# EasyEDA Pro project Athena.epro, schematic Schematic, sheet 2 of 4 (continued)
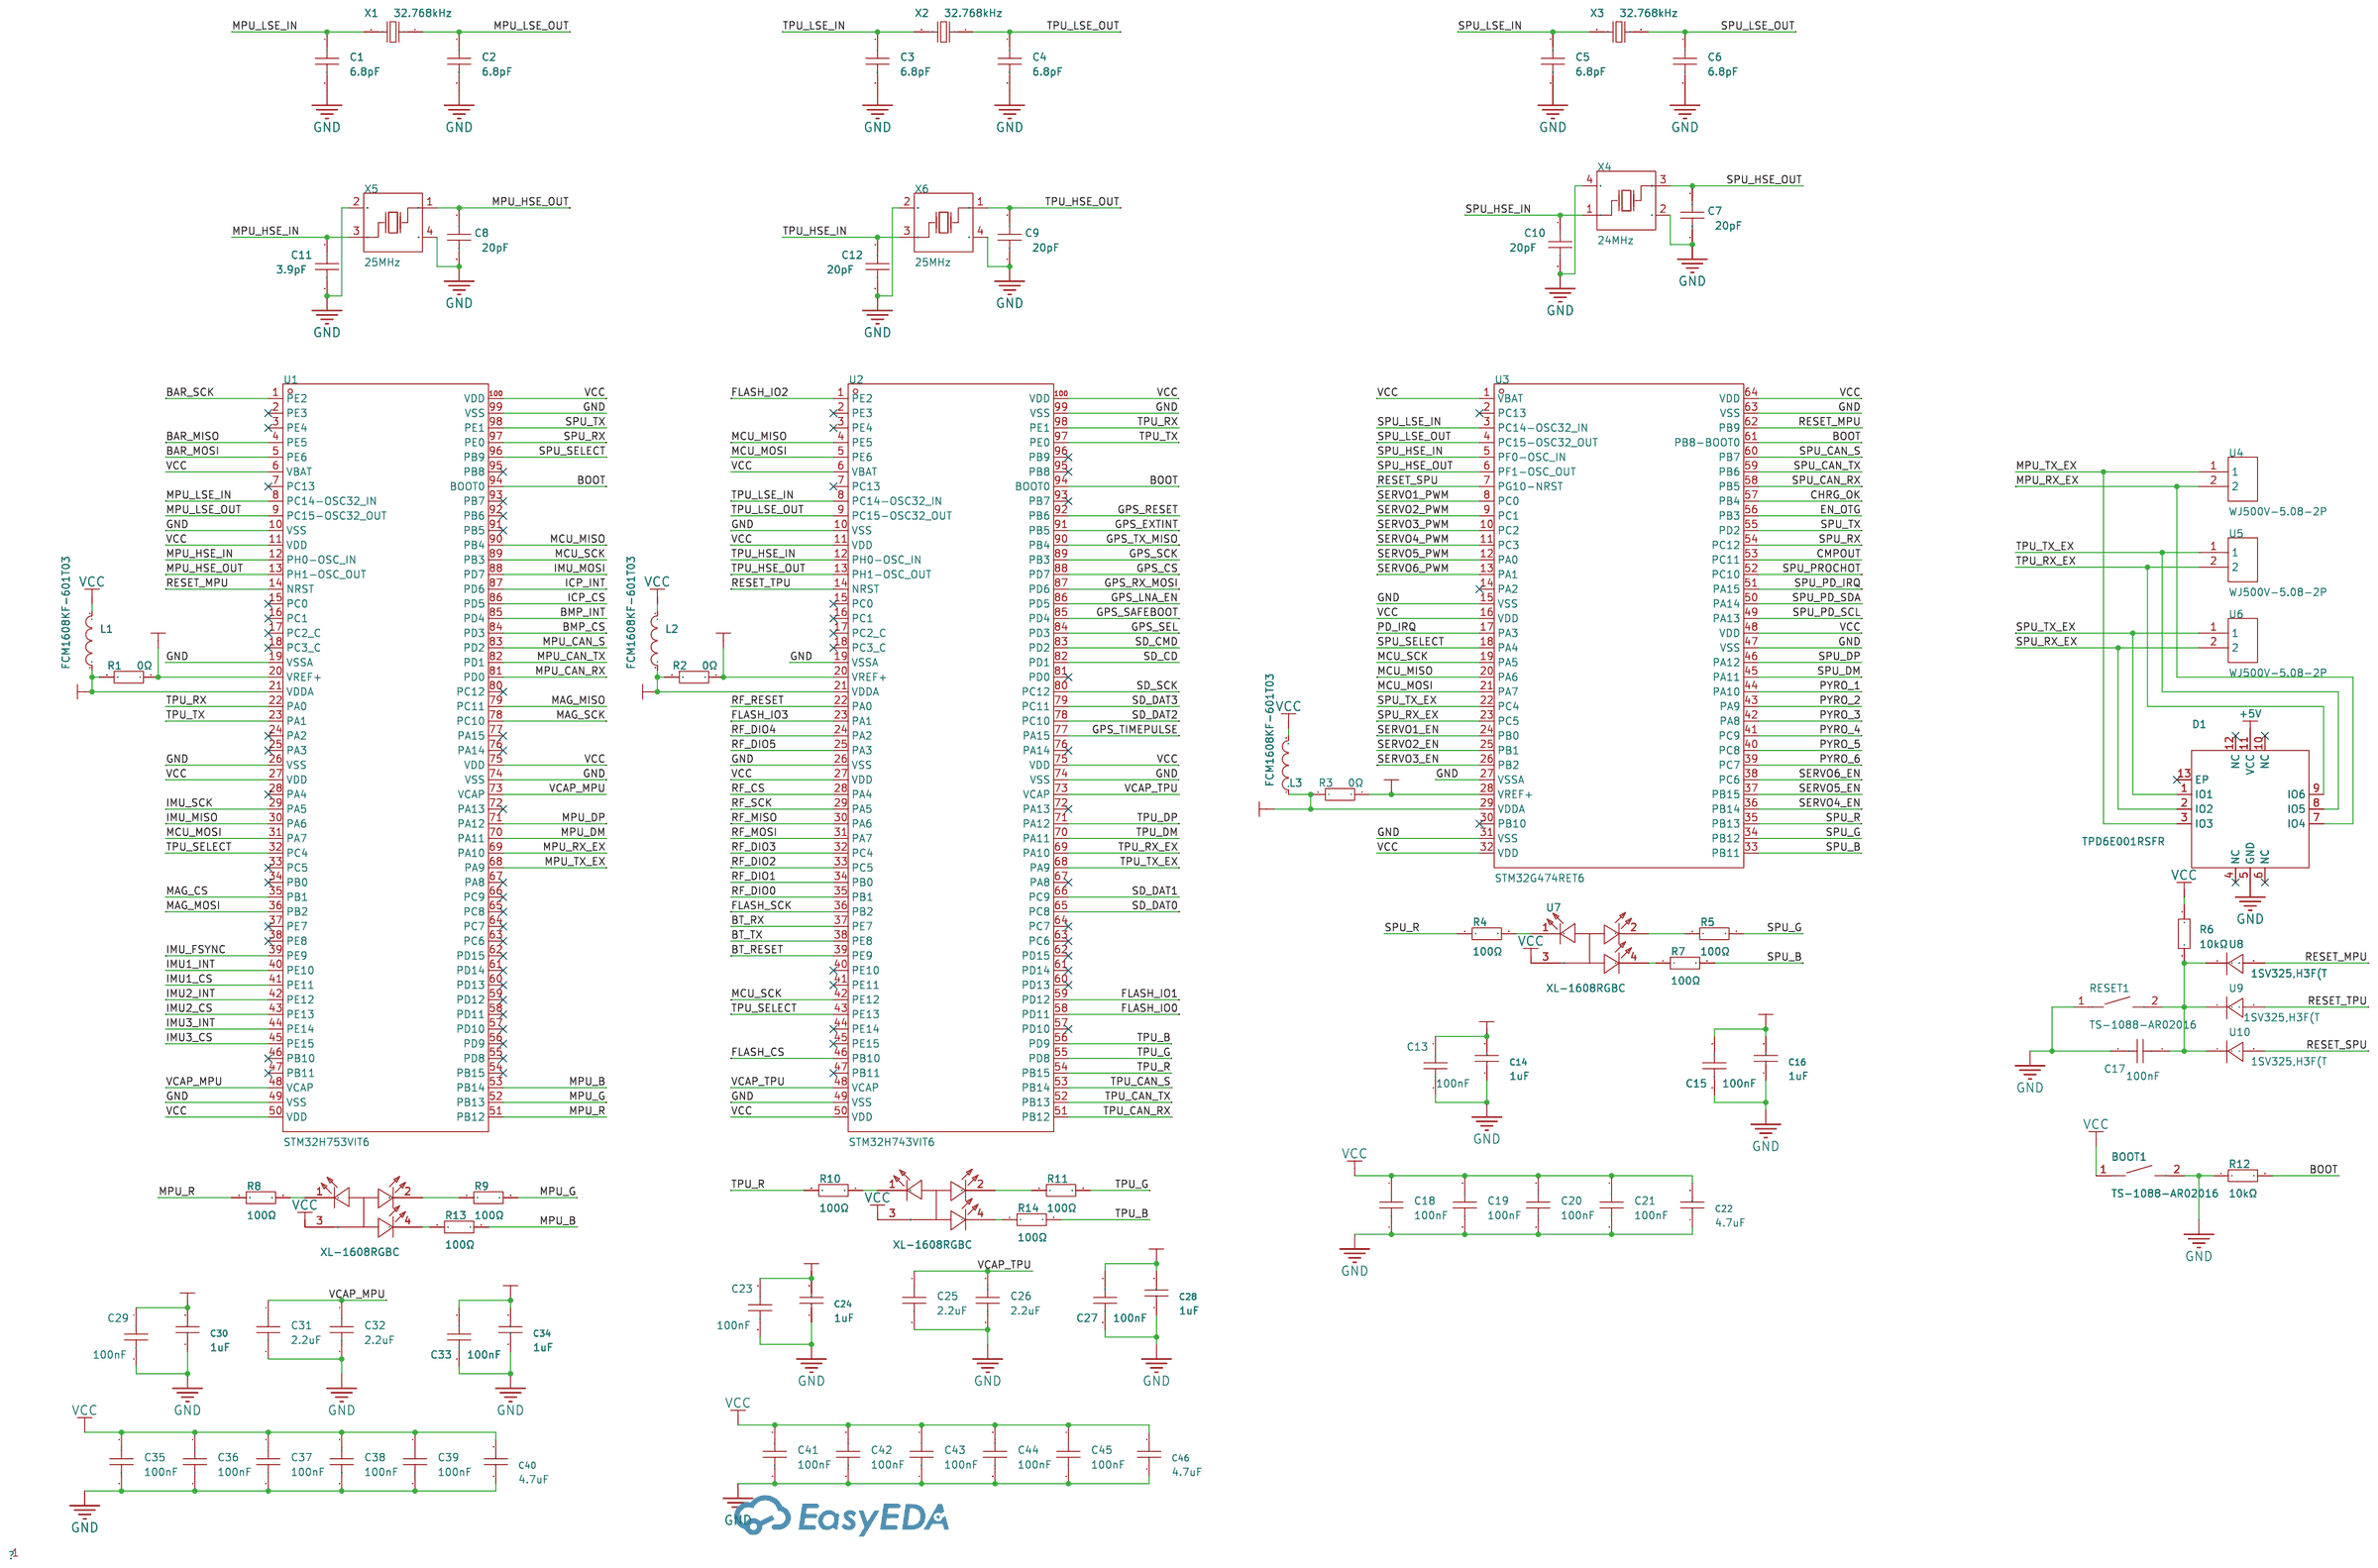
[diagram p0: Processors]
## Nets (continued)
PD_GP2: Q5.1(G) Q6.1(G)
PD_IRQ: U20.18(I2Cc_IRQ#) ; also on sheet 1
PD_SBU1: D2.15(SBU1) R25.1 R28.2 U20.26(GPIO4/USB_P/LD1)
PD_SBU2: D2.14(SBU2) R26.1 R29.2 U20.27(GPIO5/USB_N/LD2)
PD_SCL: U19.13(SCL) U20.17(I2Cc_SCL)
PD_SDA: U19.12(SDA) U20.16(I2Cc_SDA)
PPHV: C70.1 C71.1 C72.1 C73.1 C74.1 C75.1 C98.1 C99.1 C100.1 R32.1 R34.1 R35.2 R36.2 U20.21(PPHV)
REGN: C85.1 R44.1 U19.28(REGN)
SPU_PD_IRQ: U20.10(I2Ct_IRQ#) ; also on sheet 1
SPU_PD_SCL: U20.9(I2Ct_SCL) ; also on sheet 1
SPU_PD_SDA: U20.8(I2Ct_SDA) ; also on sheet 1
SPU_PROCHOT: R45.1 U19.11(PROCHOT#) ; also on sheet 1
USB_CC1: D2.4(C_CC1) D2.7(RPD_G1) USB1.4(CC1)
USB_CC2: D2.5(C_CC2) D2.6(RPD_G2) USB1.10(CC2)
USB_DN: D2.20(D1) USB1.5(DN2) USB1.7(DN1) ; also on sheet 3
USB_DP: D2.19(D2) USB1.6(DP1) USB1.8(DP2) ; also on sheet 3
USB_SBU1: D2.1(C_SBU1) USB1.9(SBU1)
USB_SBU2: D2.2(C_SBU2) USB1.3(SBU2)
VSYS: C47.2 C59.1 C63.1 C64.1 C65.1 C66.1 C67.1 C68.1 Q8.5(D) Q8.6(D) Q8.7(D) Q8.8(D) Q8.9(D) Q9.5(S) Q9.6(S) Q9.7(S) Q9.8(S) Q9.9(S) R15.2 U14.2 U17.3(VIN) U17.5(EN) U19.22(VSYS)
$2N3293: D2.9(FLT#) R31.2
$2N3500: C62.1 D2.3(VBIAS)
$2N3865: Q5.3(D) R28.1
$2N3867: Q6.3(D) R29.1
$2N3869: Q3.2(S) R25.2
$2N3871: Q4.2(S) R26.2
$2N4534: C86.1 U20.1(LDO_3V3) U20.2(ADCIN1)
$2N4632: C88.1 U20.3(ADCIN2) U20.4(LDO_1V5)
$2N6524: C96.1 R48.1
$2N6614: C97.1 R49.1
$2N6618: C92.1 R48.2 U19.16(COMP1)
$2N6648: C93.1 R49.2 U19.17(COMP2)
$2N6713: R52.1 U19.10(PSYS)
$2N6978: C95.1 U19.9(IBAT)
$2N7041: C94.1 R51.1 U19.8(IADPT)
$2N7165: R46.1 R47.1 U19.6(ILIM_HIZ)
$2N7490: C80.1 R34.2
$2N8943: C83.2 R35.1 U19.1(VBUS)
$2N9020: C81.2 R36.1 U19.3(ACP)
$2N9095: C76.1 Q7.5(D) Q7.6(D) Q7.7(D) Q7.8(D) Q7.9(D) R32.2 R37.2
$2N9137: C82.2 R37.1 U19.2(ACN)
$2N10434: Q7.4(G) U19.31(HIDRV1)
$2N10662: Q10.4(G) U19.29(LODRV1)
$2N10669: C77.2 L6.1 Q7.1(S) Q7.2(S) Q7.3(S) Q10.5(D) Q10.6(D) Q10.7(D) Q10.8(D) Q10.9(D) U19.32(SW1)
$2N10738: C77.1 U19.30(BTST1)
$2N10858: C78.1 U19.25(BTST2)
$2N10868: C78.2 L6.2 Q8.1(S) Q8.2(S) Q8.3(S) Q11.5(D) Q11.6(D) Q11.7(D) Q11.8(D) Q11.9(D) U19.23(SW2)
$2N10954: Q11.4(G) U19.26(LODRV2)
$2N11170: Q8.4(G) U19.24(HIDRV2)
$2N11948: C79.2 C84.1 Q9.1(D) Q9.2(D) Q9.3(D) R33.1 R42.2
$2N11970: Q9.4(G) U19.21(BATDRV#)
$2N11975: R42.1 U19.20(SRP)
$2N11980: R43.1 U19.19(SRN)
$2N13081: C58.2 L5.1 U17.2(SW)
$2N13097: C58.1 U17.6(CB)
$2N13288: R27.1 R30.2 U17.4(FB)
$2N22650: R50.1 R53.2 U19.18(CELL_BATPRESZ)
$2N34168: R15.1 R16.2 U13.1(EN/UVLO)
$2N34212: R20.2 U13.8(SYNCIN)
$2N34217: R21.2 U13.10(PGOOD)
$2N34232: C48.2 U13.3(SS/TRK)
$2N34237: R17.2 U13.2(RT)
$2N34482: C49.2 U13.17(BST)
$2N34623: Q1.4(G) U13.18(HO)
$2N34654: C50.2 Q1.5(D) Q1.6(D) Q1.7(D) Q1.8(D) U13.20(VIN) U14.1
$2N34904: C54.2 R22.1 U13.11(ILIM)
$2N35129: C49.1 L4.1 Q1.1(S) Q1.2(S) Q1.3(S) Q2.5(D) Q2.6(D) Q2.7(D) Q2.8(D) Q2.9(D) R22.2 U13.19(SW)
$2N35132: Q2.4(G) U13.13(LO)
$2N35591: C56.2 R24.1
$2N35748: C53.1 R19.1

Not connected (* = marked no-connect by the designer): D2 16(N.C.)* 17(N.C.)* 21(EP)*; U13 7(SYNCOUT)* 9(NC)* 15(EP)* 16(NC)* 21(EP)*; U19 33(EP)*; U20 5(GPIO0)* 6(GPIO1)* 7(GPIO2)* 13(GPIO11)* 19(GPIO3)* 36(GPIO7)* 37(GPIO6)*

## Notes on the sheets
sheet 2
- USB-C
- 5V BUCK
- USB ESD
- 3V3 BUCK
- TERMINALS
- USB POWER DELIVERY
- BATTERY CHARGER
